# EAGLE schematic Resistor_Resistor (EAGLE 8.3.0), part 32 of 43 (continued)
## Nets (continued)
N$61: R10601.2 R10602.2 R10603.2 R10604.2 R10605.2 R10606.2 R10607.2 R10608.2 R10609.2 R10610.2 R10611.2 R10612.2 R10613.2 R10614.2 R10615.2 R10616.2 R10617.2 R10618.2 R10619.2 R10620.2 R10621.2 R10622.2 R10623.2 R10624.2 R10625.2 R10626.2 R10627.2 R10628.2 R10629.2 R10630.2 R10631.2 R10632.2 R10633.2 R10634.2 R10635.2 R10636.2 R10637.2 R10638.2 R10639.2 R10640.2 R10641.2 R10642.2 R10643.2 R10644.2 R10645.2 R10646.2 R10647.2 R10648.2 R10649.2 R10650.2 R10651.2 R10652.2 R10653.2 R10654.2 R10655.2 R10656.2 R10657.2 R10658.2 R10659.2 R10660.2 R10661.2 R10662.2 R10663.2 R10664.2 R10665.2 R10666.2 R10667.2 R10668.2 R10669.2 R10670.2 R10671.2 R10672.2 R10673.2 R10674.2 R10675.2 R10676.2 R10677.2 R10678.2 R10679.2 R10680.2 R10681.2 R10682.2 R10683.2 R10684.2 R10685.2 R10686.2 R10687.2 R10688.2 R10689.2 R10690.2 R10691.2 R10692.2 R10693.2 R10694.2 R10695.2 R10696.2 R10697.2 R10698.2 R10699.2 R10700.2 R10701.2 R10702.2 R10703.2 R10704.2 R10705.2 R10706.2 R10707.2 R10708.2 R10709.2 R10710.2 R10711.2 R10712.2 R10713.2 R10714.2 R10715.2 R10716.2 R10717.2 R10718.2 R10719.2 R10720.2 R10721.2 R10722.2 R10723.2 R10724.2 R10725.2 R10726.2 R10727.2 R10728.2 R10729.2 R10730.2 R10731.2 R10732.2 R10733.2 R10734.2 R10735.2 R10736.2 R10737.2 R10738.2 R10739.2 R10740.2 R10741.2 R10742.2 R10743.2 R10744.2 R10745.2 R10746.2 R10747.2 R10748.2 R10749.2 R10750.2 R10751.2 R10752.2 R10753.2 R10754.2 R10755.2 R10756.2 R10757.2 R10758.2 R10759.2 R10760.2 R10761.2 R10762.2 R10763.2 R10764.2 R10765.2 R10766.2 R10767.2 R10768.2 R10769.2 R10770.2 R10771.2 R10772.2 R10773.2 R10774.2 R10775.2 R10776.2 R10777.2 R10778.2 R10779.2 R10780.2 R10781.2 R10782.2 R10783.2 R10784.2 R10785.2 R10786.2 R10787.2 R10788.2 R10789.2 R10790.2 R10791.2 R10792.2 R10793.2 R10794.2 R10795.2 R10796.2 R10797.2 R10798.2 R10799.2 R10800.2 R10801.1 R10802.1 R10803.1 R10804.1 R10805.1 R10806.1 R10807.1 R10808.1 R10809.1 R10810.1 R10811.1 R10812.1 R10813.1 R10814.1 R10815.1 R10816.1 R10817.1 R10818.1 R10819.1 R10820.1 R10821.1 R10822.1 R10823.1 R10824.1 R10825.1 R10826.1 R10827.1 R10828.1 R10829.1 R10830.1 R10831.1 R10832.1 R10833.1 R10834.1 R10835.1 R10836.1 R10837.1 R10838.1 R10839.1 R10840.1 R10841.1 R10842.1 R10843.1 R10844.1 R10845.1 R10846.1 R10847.1 R10848.1 R10849.1 R10850.1 R10851.1 R10852.1 R10853.1 R10854.1 R10855.1 R10856.1 R10857.1 R10858.1 R10859.1 R10860.1 R10861.1 R10862.1 R10863.1 R10864.1 R10865.1 R10866.1 R10867.1 R10868.1 R10869.1 R10870.1 R10871.1 R10872.1 R10873.1 R10874.1 R10875.1 R10876.1 R10877.1 R10878.1 R10879.1 R10880.1 R10881.1 R10882.1 R10883.1 R10884.1 R10885.1 R10886.1 R10887.1 R10888.1 R10889.1 R10890.1 R10891.1 R10892.1 R10893.1 R10894.1 R10895.1 R10896.1 R10897.1 R10898.1 R10899.1 R10900.1 R10901.1 R10902.1 R10903.1 R10904.1 R10905.1 R10906.1 R10907.1 R10908.1 R10909.1 R10910.1 R10911.1 R10912.1 R10913.1 R10914.1 R10915.1 R10916.1 R10917.1 R10918.1 R10919.1 R10920.1 R10921.1 R10922.1 R10923.1 R10924.1 R10925.1 R10926.1 R10927.1 R10928.1 R10929.1 R10930.1 R10931.1 R10932.1 R10933.1 R10934.1 R10935.1 R10936.1 R10937.1 R10938.1 R10939.1 R10940.1 R10941.1 R10942.1 R10943.1 R10944.1 R10945.1 R10946.1 R10947.1 R10948.1 R10949.1 R10950.1 R10951.1 R10952.1 R10953.1 R10954.1 R10955.1 R10956.1 R10957.1 R10958.1 R10959.1 R10960.1 R10961.1 R10962.1 R10963.1 R10964.1 R10965.1 R10966.1 R10967.1 R10968.1 R10969.1 R10970.1 R10971.1 R10972.1 R10973.1 R10974.1 R10975.1 R10976.1 R10977.1 R10978.1 R10979.1 R10980.1 R10981.1 R10982.1 R10983.1 R10984.1 R10985.1 R10986.1 R10987.1 R10988.1 R10989.1 R10990.1 R10991.1 R10992.1 R10993.1 R10994.1 R10995.1 R10996.1 R10997.1 R10998.1 R10999.1 R11000.1
N$62: R10801.2 R10802.2 R10803.2 R10804.2 R10805.2 R10806.2 R10807.2 R10808.2 R10809.2 R10810.2 R10811.2 R10812.2 R10813.2 R10814.2 R10815.2 R10816.2 R10817.2 R10818.2 R10819.2 R10820.2 R10821.2 R10822.2 R10823.2 R10824.2 R10825.2 R10826.2 R10827.2 R10828.2 R10829.2 R10830.2 R10831.2 R10832.2 R10833.2 R10834.2 R10835.2 R10836.2 R10837.2 R10838.2 R10839.2 R10840.2 R10841.2 R10842.2 R10843.2 R10844.2 R10845.2 R10846.2 R10847.2 R10848.2 R10849.2 R10850.2 R10851.2 R10852.2 R10853.2 R10854.2 R10855.2 R10856.2 R10857.2 R10858.2 R10859.2 R10860.2 R10861.2 R10862.2 R10863.2 R10864.2 R10865.2 R10866.2 R10867.2 R10868.2 R10869.2 R10870.2 R10871.2 R10872.2 R10873.2 R10874.2 R10875.2 R10876.2 R10877.2 R10878.2 R10879.2 R10880.2 R10881.2 R10882.2 R10883.2 R10884.2 R10885.2 R10886.2 R10887.2 R10888.2 R10889.2 R10890.2 R10891.2 R10892.2 R10893.2 R10894.2 R10895.2 R10896.2 R10897.2 R10898.2 R10899.2 R10900.2 R10901.2 R10902.2 R10903.2 R10904.2 R10905.2 R10906.2 R10907.2 R10908.2 R10909.2 R10910.2 R10911.2 R10912.2 R10913.2 R10914.2 R10915.2 R10916.2 R10917.2 R10918.2 R10919.2 R10920.2 R10921.2 R10922.2 R10923.2 R10924.2 R10925.2 R10926.2 R10927.2 R10928.2 R10929.2 R10930.2 R10931.2 R10932.2 R10933.2 R10934.2 R10935.2 R10936.2 R10937.2 R10938.2 R10939.2 R10940.2 R10941.2 R10942.2 R10943.2 R10944.2 R10945.2 R10946.2 R10947.2 R10948.2 R10949.2 R10950.2 R10951.2 R10952.2 R10953.2 R10954.2 R10955.2 R10956.2 R10957.2 R10958.2 R10959.2 R10960.2 R10961.2 R10962.2 R10963.2 R10964.2 R10965.2 R10966.2 R10967.2 R10968.2 R10969.2 R10970.2 R10971.2 R10972.2 R10973.2 R10974.2 R10975.2 R10976.2 R10977.2 R10978.2 R10979.2 R10980.2 R10981.2 R10982.2 R10983.2 R10984.2 R10985.2 R10986.2 R10987.2 R10988.2 R10989.2 R10990.2 R10991.2 R10992.2 R10993.2 R10994.2 R10995.2 R10996.2 R10997.2 R10998.2 R10999.2 R11000.2 R11001.1 R11002.1 R11003.1 R11004.1 R11005.1 R11006.1 R11007.1 R11008.1 R11009.1 R11010.1 R11011.1 R11012.1 R11013.1 R11014.1 R11015.1 R11016.1 R11017.1 R11018.1 R11019.1 R11020.1 R11021.1 R11022.1 R11023.1 R11024.1 R11025.1 R11026.1 R11027.1 R11028.1 R11029.1 R11030.1 R11031.1 R11032.1 R11033.1 R11034.1 R11035.1 R11036.1 R11037.1 R11038.1 R11039.1 R11040.1 R11041.1 R11042.1 R11043.1 R11044.1 R11045.1 R11046.1 R11047.1 R11048.1 R11049.1 R11050.1 R11051.1 R11052.1 R11053.1 R11054.1 R11055.1 R11056.1 R11057.1 R11058.1 R11059.1 R11060.1 R11061.1 R11062.1 R11063.1 R11064.1 R11065.1 R11066.1 R11067.1 R11068.1 R11069.1 R11070.1 R11071.1 R11072.1 R11073.1 R11074.1 R11075.1 R11076.1 R11077.1 R11078.1 R11079.1 R11080.1 R11081.1 R11082.1 R11083.1 R11084.1 R11085.1 R11086.1 R11087.1 R11088.1 R11089.1 R11090.1 R11091.1 R11092.1 R11093.1 R11094.1 R11095.1 R11096.1 R11097.1 R11098.1 R11099.1 R11100.1 R11101.1 R11102.1 R11103.1 R11104.1 R11105.1 R11106.1 R11107.1 R11108.1 R11109.1 R11110.1 R11111.1 R11112.1 R11113.1 R11114.1 R11115.1 R11116.1 R11117.1 R11118.1 R11119.1 R11120.1 R11121.1 R11122.1 R11123.1 R11124.1 R11125.1 R11126.1 R11127.1 R11128.1 R11129.1 R11130.1 R11131.1 R11132.1 R11133.1 R11134.1 R11135.1 R11136.1 R11137.1 R11138.1 R11139.1 R11140.1 R11141.1 R11142.1 R11143.1 R11144.1 R11145.1 R11146.1 R11147.1 R11148.1 R11149.1 R11150.1 R11151.1 R11152.1 R11153.1 R11154.1 R11155.1 R11156.1 R11157.1 R11158.1 R11159.1 R11160.1 R11161.1 R11162.1 R11163.1 R11164.1 R11165.1 R11166.1 R11167.1 R11168.1 R11169.1 R11170.1 R11171.1 R11172.1 R11173.1 R11174.1 R11175.1 R11176.1 R11177.1 R11178.1 R11179.1 R11180.1 R11181.1 R11182.1 R11183.1 R11184.1 R11185.1 R11186.1 R11187.1 R11188.1 R11189.1 R11190.1 R11191.1 R11192.1 R11193.1 R11194.1 R11195.1 R11196.1 R11197.1 R11198.1 R11199.1 R11200.1
N$63: R11001.2 R11002.2 R11003.2 R11004.2 R11005.2 R11006.2 R11007.2 R11008.2 R11009.2 R11010.2 R11011.2 R11012.2 R11013.2 R11014.2 R11015.2 R11016.2 R11017.2 R11018.2 R11019.2 R11020.2 R11021.2 R11022.2 R11023.2 R11024.2 R11025.2 R11026.2 R11027.2 R11028.2 R11029.2 R11030.2 R11031.2 R11032.2 R11033.2 R11034.2 R11035.2 R11036.2 R11037.2 R11038.2 R11039.2 R11040.2 R11041.2 R11042.2 R11043.2 R11044.2 R11045.2 R11046.2 R11047.2 R11048.2 R11049.2 R11050.2 R11051.2 R11052.2 R11053.2 R11054.2 R11055.2 R11056.2 R11057.2 R11058.2 R11059.2 R11060.2 R11061.2 R11062.2 R11063.2 R11064.2 R11065.2 R11066.2 R11067.2 R11068.2 R11069.2 R11070.2 R11071.2 R11072.2 R11073.2 R11074.2 R11075.2 R11076.2 R11077.2 R11078.2 R11079.2 R11080.2 R11081.2 R11082.2 R11083.2 R11084.2 R11085.2 R11086.2 R11087.2 R11088.2 R11089.2 R11090.2 R11091.2 R11092.2 R11093.2 R11094.2 R11095.2 R11096.2 R11097.2 R11098.2 R11099.2 R11100.2 R11101.2 R11102.2 R11103.2 R11104.2 R11105.2 R11106.2 R11107.2 R11108.2 R11109.2 R11110.2 R11111.2 R11112.2 R11113.2 R11114.2 R11115.2 R11116.2 R11117.2 R11118.2 R11119.2 R11120.2 R11121.2 R11122.2 R11123.2 R11124.2 R11125.2 R11126.2 R11127.2 R11128.2 R11129.2 R11130.2 R11131.2 R11132.2 R11133.2 R11134.2 R11135.2 R11136.2 R11137.2 R11138.2 R11139.2 R11140.2 R11141.2 R11142.2 R11143.2 R11144.2 R11145.2 R11146.2 R11147.2 R11148.2 R11149.2 R11150.2 R11151.2 R11152.2 R11153.2 R11154.2 R11155.2 R11156.2 R11157.2 R11158.2 R11159.2 R11160.2 R11161.2 R11162.2 R11163.2 R11164.2 R11165.2 R11166.2 R11167.2 R11168.2 R11169.2 R11170.2 R11171.2 R11172.2 R11173.2 R11174.2 R11175.2 R11176.2 R11177.2 R11178.2 R11179.2 R11180.2 R11181.2 R11182.2 R11183.2 R11184.2 R11185.2 R11186.2 R11187.2 R11188.2 R11189.2 R11190.2 R11191.2 R11192.2 R11193.2 R11194.2 R11195.2 R11196.2 R11197.2 R11198.2 R11199.2 R11200.2 R11201.1 R11202.1 R11203.1 R11204.1 R11205.1 R11206.1 R11207.1 R11208.1 R11209.1 R11210.1 R11211.1 R11212.1 R11213.1 R11214.1 R11215.1 R11216.1 R11217.1 R11218.1 R11219.1 R11220.1 R11221.1 R11222.1 R11223.1 R11224.1 R11225.1 R11226.1 R11227.1 R11228.1 R11229.1 R11230.1 R11231.1 R11232.1 R11233.1 R11234.1 R11235.1 R11236.1 R11237.1 R11238.1 R11239.1 R11240.1 R11241.1 R11242.1 R11243.1 R11244.1 R11245.1 R11246.1 R11247.1 R11248.1 R11249.1 R11250.1 R11251.1 R11252.1 R11253.1 R11254.1 R11255.1 R11256.1 R11257.1 R11258.1 R11259.1 R11260.1 R11261.1 R11262.1 R11263.1 R11264.1 R11265.1 R11266.1 R11267.1 R11268.1 R11269.1 R11270.1 R11271.1 R11272.1 R11273.1 R11274.1 R11275.1 R11276.1 R11277.1 R11278.1 R11279.1 R11280.1 R11281.1 R11282.1 R11283.1 R11284.1 R11285.1 R11286.1 R11287.1 R11288.1 R11289.1 R11290.1 R11291.1 R11292.1 R11293.1 R11294.1 R11295.1 R11296.1 R11297.1 R11298.1 R11299.1 R11300.1 R11301.1 R11302.1 R11303.1 R11304.1 R11305.1 R11306.1 R11307.1 R11308.1 R11309.1 R11310.1 R11311.1 R11312.1 R11313.1 R11314.1 R11315.1 R11316.1 R11317.1 R11318.1 R11319.1 R11320.1 R11321.1 R11322.1 R11323.1 R11324.1 R11325.1 R11326.1 R11327.1 R11328.1 R11329.1 R11330.1 R11331.1 R11332.1 R11333.1 R11334.1 R11335.1 R11336.1 R11337.1 R11338.1 R11339.1 R11340.1 R11341.1 R11342.1 R11343.1 R11344.1 R11345.1 R11346.1 R11347.1 R11348.1 R11349.1 R11350.1 R11351.1 R11352.1 R11353.1 R11354.1 R11355.1 R11356.1 R11357.1 R11358.1 R11359.1 R11360.1 R11361.1 R11362.1 R11363.1 R11364.1 R11365.1 R11366.1 R11367.1 R11368.1 R11369.1 R11370.1 R11371.1 R11372.1 R11373.1 R11374.1 R11375.1 R11376.1 R11377.1 R11378.1 R11379.1 R11380.1 R11381.1 R11382.1 R11383.1 R11384.1 R11385.1 R11386.1 R11387.1 R11388.1 R11389.1 R11390.1 R11391.1 R11392.1 R11393.1 R11394.1 R11395.1 R11396.1 R11397.1 R11398.1 R11399.1 R11400.1
N$64: R11201.2 R11202.2 R11203.2 R11204.2 R11205.2 R11206.2 R11207.2 R11208.2 R11209.2 R11210.2 R11211.2 R11212.2 R11213.2 R11214.2 R11215.2 R11216.2 R11217.2 R11218.2 R11219.2 R11220.2 R11221.2 R11222.2 R11223.2 R11224.2 R11225.2 R11226.2 R11227.2 R11228.2 R11229.2 R11230.2 R11231.2 R11232.2 R11233.2 R11234.2 R11235.2 R11236.2 R11237.2 R11238.2 R11239.2 R11240.2 R11241.2 R11242.2 R11243.2 R11244.2 R11245.2 R11246.2 R11247.2 R11248.2 R11249.2 R11250.2 R11251.2 R11252.2 R11253.2 R11254.2 R11255.2 R11256.2 R11257.2 R11258.2 R11259.2 R11260.2 R11261.2 R11262.2 R11263.2 R11264.2 R11265.2 R11266.2 R11267.2 R11268.2 R11269.2 R11270.2 R11271.2 R11272.2 R11273.2 R11274.2 R11275.2 R11276.2 R11277.2 R11278.2 R11279.2 R11280.2 R11281.2 R11282.2 R11283.2 R11284.2 R11285.2 R11286.2 R11287.2 R11288.2 R11289.2 R11290.2 R11291.2 R11292.2 R11293.2 R11294.2 R11295.2 R11296.2 R11297.2 R11298.2 R11299.2 R11300.2 R11301.2 R11302.2 R11303.2 R11304.2 R11305.2 R11306.2 R11307.2 R11308.2 R11309.2 R11310.2 R11311.2 R11312.2 R11313.2 R11314.2 R11315.2 R11316.2 R11317.2 R11318.2 R11319.2 R11320.2 R11321.2 R11322.2 R11323.2 R11324.2 R11325.2 R11326.2 R11327.2 R11328.2 R11329.2 R11330.2 R11331.2 R11332.2 R11333.2 R11334.2 R11335.2 R11336.2 R11337.2 R11338.2 R11339.2 R11340.2 R11341.2 R11342.2 R11343.2 R11344.2 R11345.2 R11346.2 R11347.2 R11348.2 R11349.2 R11350.2 R11351.2 R11352.2 R11353.2 R11354.2 R11355.2 R11356.2 R11357.2 R11358.2 R11359.2 R11360.2 R11361.2 R11362.2 R11363.2 R11364.2 R11365.2 R11366.2 R11367.2 R11368.2 R11369.2 R11370.2 R11371.2 R11372.2 R11373.2 R11374.2 R11375.2 R11376.2 R11377.2 R11378.2 R11379.2 R11380.2 R11381.2 R11382.2 R11383.2 R11384.2 R11385.2 R11386.2 R11387.2 R11388.2 R11389.2 R11390.2 R11391.2 R11392.2 R11393.2 R11394.2 R11395.2 R11396.2 R11397.2 R11398.2 R11399.2 R11400.2 R11401.1 R11402.1 R11403.1 R11404.1 R11405.1 R11406.1 R11407.1 R11408.1 R11409.1 R11410.1 R11411.1 R11412.1 R11413.1 R11414.1 R11415.1 R11416.1 R11417.1 R11418.1 R11419.1 R11420.1 R11421.1 R11422.1 R11423.1 R11424.1 R11425.1 R11426.1 R11427.1 R11428.1 R11429.1 R11430.1 R11431.1 R11432.1 R11433.1 R11434.1 R11435.1 R11436.1 R11437.1 R11438.1 R11439.1 R11440.1 R11441.1 R11442.1 R11443.1 R11444.1 R11445.1 R11446.1 R11447.1 R11448.1 R11449.1 R11450.1 R11451.1 R11452.1 R11453.1 R11454.1 R11455.1 R11456.1 R11457.1 R11458.1 R11459.1 R11460.1 R11461.1 R11462.1 R11463.1 R11464.1 R11465.1 R11466.1 R11467.1 R11468.1 R11469.1 R11470.1 R11471.1 R11472.1 R11473.1 R11474.1 R11475.1 R11476.1 R11477.1 R11478.1 R11479.1 R11480.1 R11481.1 R11482.1 R11483.1 R11484.1 R11485.1 R11486.1 R11487.1 R11488.1 R11489.1 R11490.1 R11491.1 R11492.1 R11493.1 R11494.1 R11495.1 R11496.1 R11497.1 R11498.1 R11499.1 R11500.1 R11501.1 R11502.1 R11503.1 R11504.1 R11505.1 R11506.1 R11507.1 R11508.1 R11509.1 R11510.1 R11511.1 R11512.1 R11513.1 R11514.1 R11515.1 R11516.1 R11517.1 R11518.1 R11519.1 R11520.1 R11521.1 R11522.1 R11523.1 R11524.1 R11525.1 R11526.1 R11527.1 R11528.1 R11529.1 R11530.1 R11531.1 R11532.1 R11533.1 R11534.1 R11535.1 R11536.1 R11537.1 R11538.1 R11539.1 R11540.1 R11541.1 R11542.1 R11543.1 R11544.1 R11545.1 R11546.1 R11547.1 R11548.1 R11549.1 R11550.1 R11551.1 R11552.1 R11553.1 R11554.1 R11555.1 R11556.1 R11557.1 R11558.1 R11559.1 R11560.1 R11561.1 R11562.1 R11563.1 R11564.1 R11565.1 R11566.1 R11567.1 R11568.1 R11569.1 R11570.1 R11571.1 R11572.1 R11573.1 R11574.1 R11575.1 R11576.1 R11577.1 R11578.1 R11579.1 R11580.1 R11581.1 R11582.1 R11583.1 R11584.1 R11585.1 R11586.1 R11587.1 R11588.1 R11589.1 R11590.1 R11591.1 R11592.1 R11593.1 R11594.1 R11595.1 R11596.1 R11597.1 R11598.1 R11599.1 R11600.1
N$65: R11401.2 R11402.2 R11403.2 R11404.2 R11405.2 R11406.2 R11407.2 R11408.2 R11409.2 R11410.2 R11411.2 R11412.2 R11413.2 R11414.2 R11415.2 R11416.2 R11417.2 R11418.2 R11419.2 R11420.2 R11421.2 R11422.2 R11423.2 R11424.2 R11425.2 R11426.2 R11427.2 R11428.2 R11429.2 R11430.2 R11431.2 R11432.2 R11433.2 R11434.2 R11435.2 R11436.2 R11437.2 R11438.2 R11439.2 R11440.2 R11441.2 R11442.2 R11443.2 R11444.2 R11445.2 R11446.2 R11447.2 R11448.2 R11449.2 R11450.2 R11451.2 R11452.2 R11453.2 R11454.2 R11455.2 R11456.2 R11457.2 R11458.2 R11459.2 R11460.2 R11461.2 R11462.2 R11463.2 R11464.2 R11465.2 R11466.2 R11467.2 R11468.2 R11469.2 R11470.2 R11471.2 R11472.2 R11473.2 R11474.2 R11475.2 R11476.2 R11477.2 R11478.2 R11479.2 R11480.2 R11481.2 R11482.2 R11483.2 R11484.2 R11485.2 R11486.2 R11487.2 R11488.2 R11489.2 R11490.2 R11491.2 R11492.2 R11493.2 R11494.2 R11495.2 R11496.2 R11497.2 R11498.2 R11499.2 R11500.2 R11501.2 R11502.2 R11503.2 R11504.2 R11505.2 R11506.2 R11507.2 R11508.2 R11509.2 R11510.2 R11511.2 R11512.2 R11513.2 R11514.2 R11515.2 R11516.2 R11517.2 R11518.2 R11519.2 R11520.2 R11521.2 R11522.2 R11523.2 R11524.2 R11525.2 R11526.2 R11527.2 R11528.2 R11529.2 R11530.2 R11531.2 R11532.2 R11533.2 R11534.2 R11535.2 R11536.2 R11537.2 R11538.2 R11539.2 R11540.2 R11541.2 R11542.2 R11543.2 R11544.2 R11545.2 R11546.2 R11547.2 R11548.2 R11549.2 R11550.2 R11551.2 R11552.2 R11553.2 R11554.2 R11555.2 R11556.2 R11557.2 R11558.2 R11559.2 R11560.2 R11561.2 R11562.2 R11563.2 R11564.2 R11565.2 R11566.2 R11567.2 R11568.2 R11569.2 R11570.2 R11571.2 R11572.2 R11573.2 R11574.2 R11575.2 R11576.2 R11577.2 R11578.2 R11579.2 R11580.2 R11581.2 R11582.2 R11583.2 R11584.2 R11585.2 R11586.2 R11587.2 R11588.2 R11589.2 R11590.2 R11591.2 R11592.2 R11593.2 R11594.2 R11595.2 R11596.2 R11597.2 R11598.2 R11599.2 R11600.2 R11601.1 R11602.1 R11603.1 R11604.1 R11605.1 R11606.1 R11607.1 R11608.1 R11609.1 R11610.1 R11611.1 R11612.1 R11613.1 R11614.1 R11615.1 R11616.1 R11617.1 R11618.1 R11619.1 R11620.1 R11621.1 R11622.1 R11623.1 R11624.1 R11625.1 R11626.1 R11627.1 R11628.1 R11629.1 R11630.1 R11631.1 R11632.1 R11633.1 R11634.1 R11635.1 R11636.1 R11637.1 R11638.1 R11639.1 R11640.1 R11641.1 R11642.1 R11643.1 R11644.1 R11645.1 R11646.1 R11647.1 R11648.1 R11649.1 R11650.1 R11651.1 R11652.1 R11653.1 R11654.1 R11655.1 R11656.1 R11657.1 R11658.1 R11659.1 R11660.1 R11661.1 R11662.1 R11663.1 R11664.1 R11665.1 R11666.1 R11667.1 R11668.1 R11669.1 R11670.1 R11671.1 R11672.1 R11673.1 R11674.1 R11675.1 R11676.1 R11677.1 R11678.1 R11679.1 R11680.1 R11681.1 R11682.1 R11683.1 R11684.1 R11685.1 R11686.1 R11687.1 R11688.1 R11689.1 R11690.1 R11691.1 R11692.1 R11693.1 R11694.1 R11695.1 R11696.1 R11697.1 R11698.1 R11699.1 R11700.1 R11701.1 R11702.1 R11703.1 R11704.1 R11705.1 R11706.1 R11707.1 R11708.1 R11709.1 R11710.1 R11711.1 R11712.1 R11713.1 R11714.1 R11715.1 R11716.1 R11717.1 R11718.1 R11719.1 R11720.1 R11721.1 R11722.1 R11723.1 R11724.1 R11725.1 R11726.1 R11727.1 R11728.1 R11729.1 R11730.1 R11731.1 R11732.1 R11733.1 R11734.1 R11735.1 R11736.1 R11737.1 R11738.1 R11739.1 R11740.1 R11741.1 R11742.1 R11743.1 R11744.1 R11745.1 R11746.1 R11747.1 R11748.1 R11749.1 R11750.1 R11751.1 R11752.1 R11753.1 R11754.1 R11755.1 R11756.1 R11757.1 R11758.1 R11759.1 R11760.1 R11761.1 R11762.1 R11763.1 R11764.1 R11765.1 R11766.1 R11767.1 R11768.1 R11769.1 R11770.1 R11771.1 R11772.1 R11773.1 R11774.1 R11775.1 R11776.1 R11777.1 R11778.1 R11779.1 R11780.1 R11781.1 R11782.1 R11783.1 R11784.1 R11785.1 R11786.1 R11787.1 R11788.1 R11789.1 R11790.1 R11791.1 R11792.1 R11793.1 R11794.1 R11795.1 R11796.1 R11797.1 R11798.1 R11799.1 R11800.1
N$66: R11601.2 R11602.2 R11603.2 R11604.2 R11605.2 R11606.2 R11607.2 R11608.2 R11609.2 R11610.2 R11611.2 R11612.2 R11613.2 R11614.2 R11615.2 R11616.2 R11617.2 R11618.2 R11619.2 R11620.2 R11621.2 R11622.2 R11623.2 R11624.2 R11625.2 R11626.2 R11627.2 R11628.2 R11629.2 R11630.2 R11631.2 R11632.2 R11633.2 R11634.2 R11635.2 R11636.2 R11637.2 R11638.2 R11639.2 R11640.2 R11641.2 R11642.2 R11643.2 R11644.2 R11645.2 R11646.2 R11647.2 R11648.2 R11649.2 R11650.2 R11651.2 R11652.2 R11653.2 R11654.2 R11655.2 R11656.2 R11657.2 R11658.2 R11659.2 R11660.2 R11661.2 R11662.2 R11663.2 R11664.2 R11665.2 R11666.2 R11667.2 R11668.2 R11669.2 R11670.2 R11671.2 R11672.2 R11673.2 R11674.2 R11675.2 R11676.2 R11677.2 R11678.2 R11679.2 R11680.2 R11681.2 R11682.2 R11683.2 R11684.2 R11685.2 R11686.2 R11687.2 R11688.2 R11689.2 R11690.2 R11691.2 R11692.2 R11693.2 R11694.2 R11695.2 R11696.2 R11697.2 R11698.2 R11699.2 R11700.2 R11701.2 R11702.2 R11703.2 R11704.2 R11705.2 R11706.2 R11707.2 R11708.2 R11709.2 R11710.2 R11711.2 R11712.2 R11713.2 R11714.2 R11715.2 R11716.2 R11717.2 R11718.2 R11719.2 R11720.2 R11721.2 R11722.2 R11723.2 R11724.2 R11725.2 R11726.2 R11727.2 R11728.2 R11729.2 R11730.2 R11731.2 R11732.2 R11733.2 R11734.2 R11735.2 R11736.2 R11737.2 R11738.2 R11739.2 R11740.2 R11741.2 R11742.2 R11743.2 R11744.2 R11745.2 R11746.2 R11747.2 R11748.2 R11749.2 R11750.2 R11751.2 R11752.2 R11753.2 R11754.2 R11755.2 R11756.2 R11757.2 R11758.2 R11759.2 R11760.2 R11761.2 R11762.2 R11763.2 R11764.2 R11765.2 R11766.2 R11767.2 R11768.2 R11769.2 R11770.2 R11771.2 R11772.2 R11773.2 R11774.2 R11775.2 R11776.2 R11777.2 R11778.2 R11779.2 R11780.2 R11781.2 R11782.2 R11783.2 R11784.2 R11785.2 R11786.2 R11787.2 R11788.2 R11789.2 R11790.2 R11791.2 R11792.2 R11793.2 R11794.2 R11795.2 R11796.2 R11797.2 R11798.2 R11799.2 R11800.2 R11801.1 R11802.1 R11803.1 R11804.1 R11805.1 R11806.1 R11807.1 R11808.1 R11809.1 R11810.1 R11811.1 R11812.1 R11813.1 R11814.1 R11815.1 R11816.1 R11817.1 R11818.1 R11819.1 R11820.1 R11821.1 R11822.1 R11823.1 R11824.1 R11825.1 R11826.1 R11827.1 R11828.1 R11829.1 R11830.1 R11831.1 R11832.1 R11833.1 R11834.1 R11835.1 R11836.1 R11837.1 R11838.1 R11839.1 R11840.1 R11841.1 R11842.1 R11843.1 R11844.1 R11845.1 R11846.1 R11847.1 R11848.1 R11849.1 R11850.1 R11851.1 R11852.1 R11853.1 R11854.1 R11855.1 R11856.1 R11857.1 R11858.1 R11859.1 R11860.1 R11861.1 R11862.1 R11863.1 R11864.1 R11865.1 R11866.1 R11867.1 R11868.1 R11869.1 R11870.1 R11871.1 R11872.1 R11873.1 R11874.1 R11875.1 R11876.1 R11877.1 R11878.1 R11879.1 R11880.1 R11881.1 R11882.1 R11883.1 R11884.1 R11885.1 R11886.1 R11887.1 R11888.1 R11889.1 R11890.1 R11891.1 R11892.1 R11893.1 R11894.1 R11895.1 R11896.1 R11897.1 R11898.1 R11899.1 R11900.1 R11901.1 R11902.1 R11903.1 R11904.1 R11905.1 R11906.1 R11907.1 R11908.1 R11909.1 R11910.1 R11911.1 R11912.1 R11913.1 R11914.1 R11915.1 R11916.1 R11917.1 R11918.1 R11919.1 R11920.1 R11921.1 R11922.1 R11923.1 R11924.1 R11925.1 R11926.1 R11927.1 R11928.1 R11929.1 R11930.1 R11931.1 R11932.1 R11933.1 R11934.1 R11935.1 R11936.1 R11937.1 R11938.1 R11939.1 R11940.1 R11941.1 R11942.1 R11943.1 R11944.1 R11945.1 R11946.1 R11947.1 R11948.1 R11949.1 R11950.1 R11951.1 R11952.1 R11953.1 R11954.1 R11955.1 R11956.1 R11957.1 R11958.1 R11959.1 R11960.1 R11961.1 R11962.1 R11963.1 R11964.1 R11965.1 R11966.1 R11967.1 R11968.1 R11969.1 R11970.1 R11971.1 R11972.1 R11973.1 R11974.1 R11975.1 R11976.1 R11977.1 R11978.1 R11979.1 R11980.1 R11981.1 R11982.1 R11983.1 R11984.1 R11985.1 R11986.1 R11987.1 R11988.1 R11989.1 R11990.1 R11991.1 R11992.1 R11993.1 R11994.1 R11995.1 R11996.1 R11997.1 R11998.1 R11999.1 R12000.1